# EasyEDA Pro project cubicat_pcb.eprj, schematic Schematic_audio_sdcard_lcd
Create Date: 2024-12-24; Page Name: P1; Project Name: cubicat_CS3; Schematic Name: Schematic_audio_sdcard_lcd; Update Date: 2024-12-24; Company: 嘉立创EDA; Page Size: A4; Version: V1.0
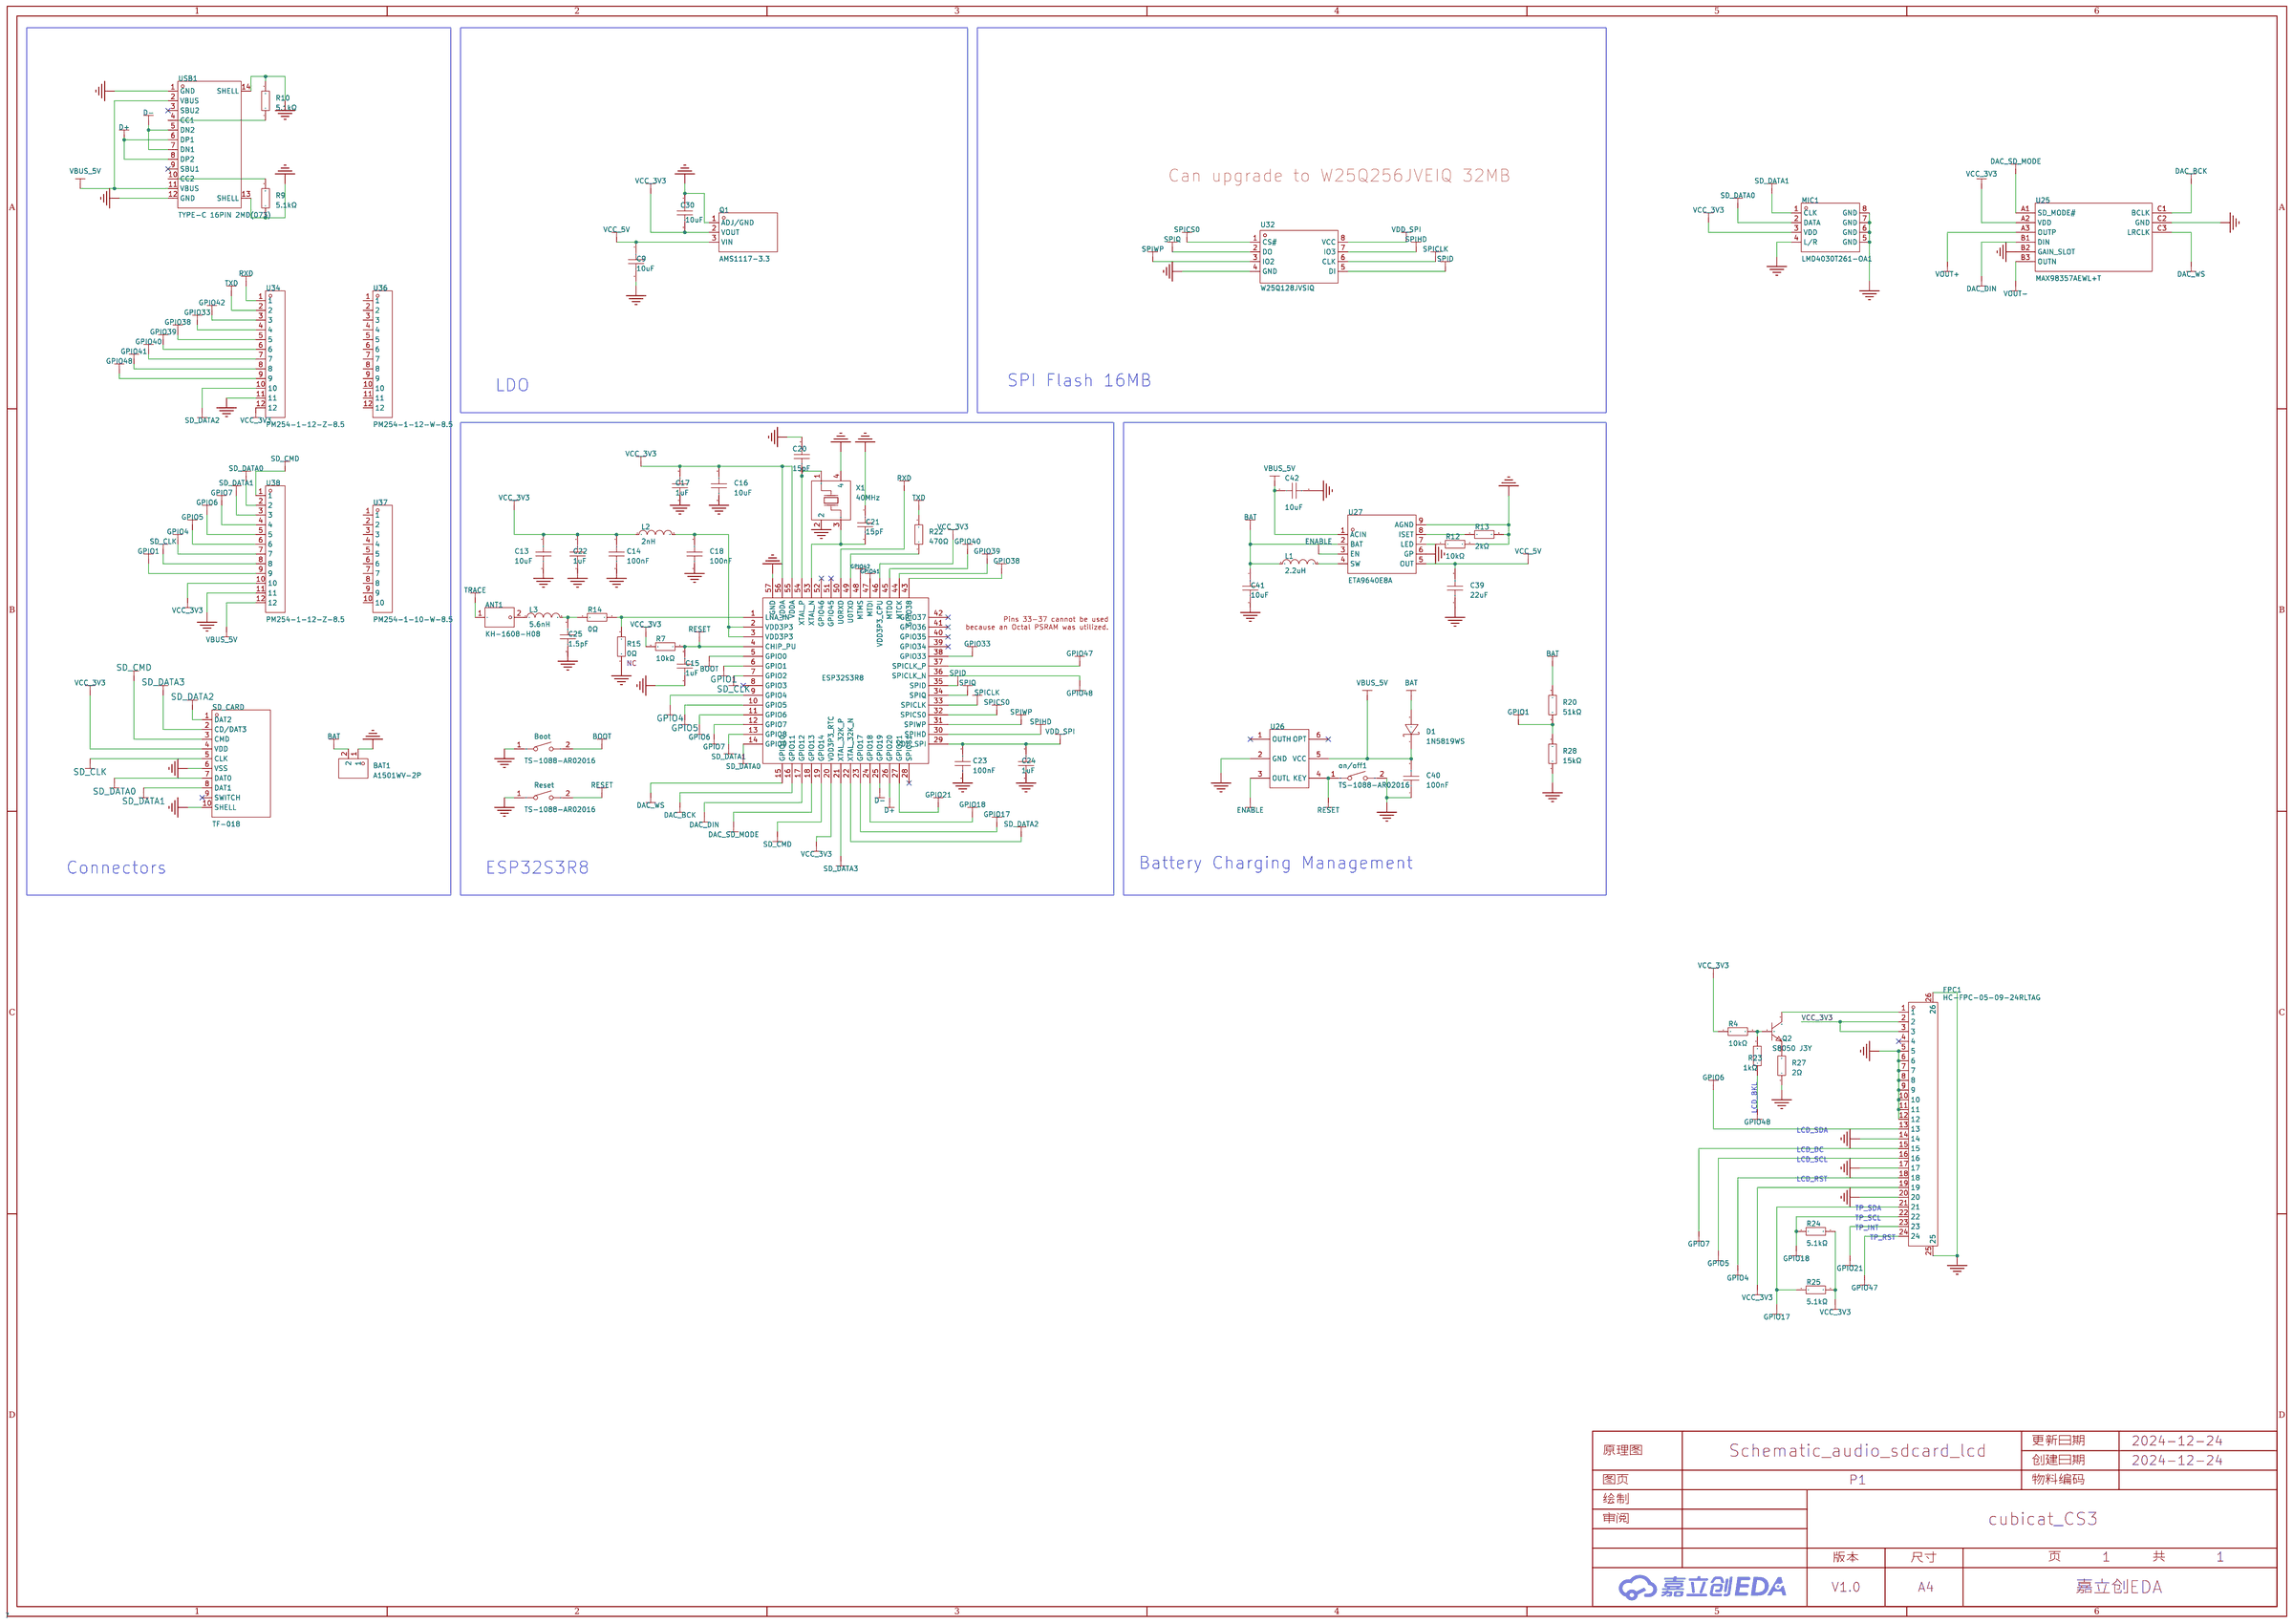
[diagram p3: schematic sheet]

## Parts
ANT1  KH-1608-H08  [ANT-SMD_L1.7-W0.9]
BAT1  A1501WV-2P  [CONN-TH_A1501WV-2P]  (no BOM)
Boot  TS-1088-AR02016  [SW-SMD_L3.9-W3.0-P4.45]
C9  10uF  [C0402]
C13  10uF  [C0402]
C14  100nF  [C0402]
C15  1uF  [C0402]
C16  10uF  [C0402]
C17  1uF  [C0402]
C18  100nF  [C0402]
C20  15pF  [C0402]
C21  15pF  [C0402]
C22  1uF  [C0402]
C23  100nF  [C0402]
C24  1uF  [C0402]
C25  1.5pF  [C0402]
C30  10uF  [C0402]
C39  22uF  [C0603]
C40  100nF  [C0402]
C41  10uF  [C0402]
C42  10uF  [C0402]
D1  1N5819WS  [SOD-323_L1.8-W1.3-LS2.5-RD]
ESP32S3R8  -  [esp32s3R8]
FPC1  HC-FPC-05-09-24RLTAG  [FPC-SMD_24P-P0.50_HC-FPC-05-09-24RLTAG]
L1  2.2uH  [IND-SMD_L2.5-W2.0_MHCHL2520]
L2  2nH  [L0402]
L3  5.6nH  [L0402]
MIC1  LMD4030T261-OA1  [MIC-SMD_8P-L4.0-W3.0]
on/off1  TS-1088-AR02016  [SW-SMD_L3.9-W3.0-P4.45]
Q1  AMS1117-3.3  [SOT-89_L4.5-W2.5-P1.50-LS4.2-BR]
Q2  S8050 J3Y  [SOT-23-3_L3.0-W1.7-P0.95-LS2.9-BR]
R4  10kΩ  [R0402]
R7  10kΩ  [R0402]
R9  5.1kΩ  [R0402]
R10  5.1kΩ  [R0402]
R12  10kΩ  [R0402]
R13  2kΩ  [R0402]
R14  0Ω  [R0402]
R15  0Ω  [R0402]  (no BOM)
R20  51kΩ  [R0402]
R22  470Ω  [R0402]
R23  1kΩ  [R0402]
R24  5.1kΩ  [R0402]
R25  5.1kΩ  [R0402]
R27  2Ω  [R0603]
R28  15kΩ  [R0402]
Reset  TS-1088-AR02016  [SW-SMD_L3.9-W3.0-P4.45]
SD_CARD  TF-018  [TF-SMD_TF-018]  (no BOM)
U25  MAX98357AEWL+T  [WLP-9_L1.4-W1.3-P0.40-R3-C3-BR]
U26  -  [HK015T]
U27  ETA9640E8A  [ESOP-8_L4.9-W3.9-P1.27-LS6.0-BL-EP-1]
U32  W25Q128JVSIQ  [SOIC-8_L5.3-W5.3-P1.27-LS8.0-BL]
U34  PM254-1-12-Z-8.5  [HDR-TH_12P-P2.54-V-F]  (no BOM)
U36  PM254-1-12-W-8.5  [HDR-TH_12P-P2.54-H-F-W10.0-N]
U37  PM254-1-10-W-8.5  [HDR-TH_10P-P2.54-H-F-W10.0-N]
U38  PM254-1-12-Z-8.5  [HDR-TH_12P-P2.54-V-F]  (no BOM)
USB1  TYPE-C 16PIN 2MD(073)  [USB-C-SMD_TYPE-C-6PIN-2MD-073]
X1  40MHz  [osc-smd_4p-l3.2-w2.5-bl_sit8008bi]

## Library data of the parts
ANT1 = KH-1608-H08: Supplier Part: C2925416; Manufacturer: kinghelm(金航标); Supplier Footprint: 0603; JLCPCB Part Class: 扩展库; Datasheet: https://atta.szlcsc.com/upload/public/pdf/source/20211126/3EE7BF0E326A51E5D543950E9041E299.pdf; Supplier: LCSC
BAT1 = A1501WV-2P: 插针结构:1x2P;间距:1.5mm;安装方式:-;参考系列:ZH;总PIN数:2P;排数:1;每排PIN数:2;行距:-;触头材质:黄铜;; LCSC Part Name: 系列:ZH 间距:1.5mm 1x2P; Supplier Part: C225132; Manufacturer: CJT(长江连接器); Supplier Footprint: 插件,P=1.5mm; JLCPCB Part Class: 扩展库; Datasheet: https://atta.szlcsc.com/upload/public/pdf/source/20180928/C273012_BDE11A7ED864817C692E5CB548553229.pdf; Supplier: LCSC; Pins Structure: 1x2P; Pitch: 1.5mm; Reference Series: ZH; Number of Pins: 2P; Number of Rows: 1; Number of PINs Per Row: 2; Contact Material: 黄铜
Boot on/off1 Reset = TS-1088-AR02016: 电路结构:单刀单掷;按钮形状:圆形按钮;作用力:160gf;安装方式:立贴;开关长度:4mm;开关宽度:3mm;开关高度:2mm;带支架:不带;触点电流:50mA;额定电压(DC):12V;绝缘电阻:100MΩ;机械寿命:10万次;; LCSC Part Name: 4*3*2mm 立贴 轻触开关; Supplier Part: C720477; Manufacturer: XUNPU(讯普); Supplier Footprint: SMD; JLCPCB Part Class: 扩展库; Datasheet: https://atta.szlcsc.com/upload/public/pdf/source/20200810/C720475_60D09DD6C54279ADDB2DC25100F1CC11.pdf; Supplier: LCSC; Circuit: 单刀单掷; Actuator Style: 圆形按钮; Operating Force: 160gf; Mounting Style: 立贴; Switch Length: 4mm; Switch Width: 3mm; Switch Height: 2mm; Strike Gundam: 不带; Contact Current: 50mA; Voltage Rating (DC): 12V; Insulation Resistance: 100MΩ; Actuator/Cap Color: 黑色; Pin Style: SMD接片; Mechanical Life: 10万次; Operating Temperature: -30℃~+80℃
C9 C13 C16 C30 C41 C42 = CL05A106MQ5NUNC: 容值:10uF;精度:±20%;额定电压:6.3V;材质(温度系数):X5R;; LCSC Part Name: 10uF ±20% 6.3V; Supplier Part: C15525; Manufacturer: SAMSUNG(三星); Supplier Footprint: 0402; JLCPCB Part Class: Basic Part; Datasheet: https://atta.szlcsc.com/upload/public/pdf/source/20220823/2B02EE04F8F211D38A52DCB16EB6BEBA.pdf; Supplier: LCSC; Tolerance: ±20%; Voltage Rated: 6.3V; Temperature Coefficient: X5R
C14 C18 C23 C40 = CL05B104KO5NNNC: 容值:100nF;精度:±10%;额定电压:16V;材质(温度系数):X7R;; LCSC Part Name: 100nF ±10% 16V; Supplier Part: C1525; Manufacturer: SAMSUNG(三星); Supplier Footprint: 0402; JLCPCB Part Class: Basic Part; Datasheet: https://atta.szlcsc.com/upload/public/pdf/source/20160218/1457707763339.pdf; Supplier: LCSC; Tolerance: ±10%; Voltage Rated: 16V; Temperature Coefficient: X7R
C15 C17 C22 C24 = CL05A105KA5NQNC: 容值:1uF;精度:±10%;额定电压:25V;材质(温度系数):X5R;; LCSC Part Name: 1uF ±10% 25V; Supplier Part: C52923; Manufacturer: SAMSUNG(三星); Supplier Footprint: 0402; JLCPCB Part Class: Basic Part; Datasheet: https://atta.szlcsc.com/upload/public/pdf/source/20160218/1457707763339.pdf; Supplier: LCSC; Tolerance: ±10%; Voltage Rated: 25V; Temperature Coefficient: X5R
C20 C21 = 0402CG150J500NT: 容值:15pF;精度:±5%;额定电压:50V;材质(温度系数):C0G;; LCSC Part Name: 15pF ±5% 50V; Supplier Part: C1548; Manufacturer: FH(风华); Supplier Footprint: 0402; JLCPCB Part Class: Basic Part; Datasheet: https://atta.szlcsc.com/upload/public/pdf/source/20200305/C486355_26A10D38EF8C2A5C37091D0039909270.pdf; Supplier: LCSC; Tolerance: ±5%; Voltage Rated: 50V; Temperature Coefficient: C0G
C25 = CC0402BRNPO9BN1R5: 容值:1.5pF;额定电压:50V;材质(温度系数):NP0;; LCSC Part Name: 1.5pF 50V; Supplier Part: C282238; Manufacturer: YAGEO(国巨); Supplier Footprint: 0402; JLCPCB Part Class: Extended Part; Datasheet: https://atta.szlcsc.com/upload/public/pdf/source/20181008/C309499_21CC21451B82C39E3D92150FD6B30293.pdf; Supplier: LCSC; Voltage Rated: 50V; Temperature Coefficient: NP0
C39 = CL10A226MQ8NRNC: 容值:22uF;精度:±20%;额定电压:6.3V;材质(温度系数):X5R;; LCSC Part Name: 22uF ±20% 6.3V; Supplier Part: C59461; Manufacturer: SAMSUNG(三星); Supplier Footprint: 0603; JLCPCB Part Class: 基础库; Datasheet: https://atta.szlcsc.com/upload/public/pdf/source/20160218/1457707763339.pdf; Supplier: LCSC; Tolerance: ±20%; Voltage Rated: 6.3V; Temperature Coefficient: X5R
D1 = 1N5819WS_C191023: 正向压降(Vf):600mV@1A;直流反向耐压(Vr):40V;平均整流电流(Io):1A;; LCSC Part Name: 电压:40V 电流:1A; Supplier Part: C191023; Manufacturer: Hottech(合科泰); Supplier Footprint: SOD-323; JLCPCB Part Class: 基础库; Datasheet: https://atta.szlcsc.com/upload/public/pdf/source/20220428/3CB86FD8D28D653594B4E35F9D5AEFD9.pdf; Supplier: LCSC; Forward Voltage (Vf@If): 600mV@1A; Reverse Voltage (Vr): 40V; Average Rectified Current (Io): 1A
ESP32S3R8 = esp32s3R8
FPC1 = HC-FPC-05-09-24RLTAG: 锁定特性:翻盖式;触点类型:双侧触点/上下接;触点数量:24P;间距:0.5mm;安装类型:卧贴;工作温度范围:-55℃~+85℃;; LCSC Part Name: 翻盖式 双侧触点/上下接 P数:24P 间距:0.5mm; Supplier Part: C5213757; Manufacturer: HCTL(华灿天禄); Supplier Footprint: SMD,P=0.5mm,卧贴; JLCPCB Part Class: 扩展库; Datasheet: https://atta.szlcsc.com/upload/public/pdf/source/20221026/52A26161A88FCE07A06989F8D4399614.pdf; Supplier: LCSC; Locking Feature: 翻盖式; Contact Type: 双侧触点/上下接; Number of Contacts: 24P; Pitch: 0.5mm; Mounting Type: 卧贴; FFC, FCB Thickness: 0.3mm; Height Above Board: 1mm; Contact Material: 铜合金; Operating Temperature Range: -55℃~+85℃
L1 = FTC252012S2R2MBCA: 电感值:2.2uH;精度:±20%;额定电流:3A;饱和电流(Isat):3.8A;类型:一体成型电感;; LCSC Part Name: 2.2uH ±20% 3.8A; Supplier Part: C5832372; Manufacturer: cjiang(长江微电); Supplier Footprint: 1008; JLCPCB Part Class: Extended Part; Datasheet: https://atta.szlcsc.com/upload/public/pdf/source/20230602/8FFEDA9C0247A92A0D4B67554BFE4091.pdf; Supplier: LCSC; Tolerance: ±20%; Rated Current: 3A; Saturation Current (Isat): 3.8A; DC Resistance (DCR): 55mΩ; Type: 一体成型电感
L2 = MLG1005S2N0BT000: 电感值:2nH;精度:-;额定电流:900mA;饱和电流(Isat):-;直流电阻(DCR):70mΩ;; Supplier Part: C76769; Manufacturer: TDK; Supplier Footprint: 0402; JLCPCB Part Class: 扩展库; Datasheet: https://atta.szlcsc.com/upload/public/pdf/source/20190403/C275259_14D38AC9DF218780897673DFAA345BA3.pdf; Supplier: LCSC; Rated Current: 900mA; DC Resistance (DCR): 70mΩ; Q @ Freq: 7@100MHz; Frequency - Self Resonant: 7.5GHz
L3 = LQG15HS5N6S02D: 电感值:5.6nH;精度:-;额定电流:650mA;饱和电流(Isat):-;直流电阻(DCR):180mΩ;; Supplier Part: C85670; Manufacturer: muRata(村田); Supplier Footprint: 0402; JLCPCB Part Class: Extended Part; Datasheet: https://atta.szlcsc.com/upload/public/pdf/source/20180612/C185484_14F678484DDF036353DC67B6265A9221.pdf; Supplier: LCSC; Rated Current: 650mA; DC Resistance (DCR): 180mΩ; Q @ Freq: 8@100MHz; Frequency - Self Resonant: 4.5GHz; Type: 厚膜电感
MIC1 = LMD4030T261-OA1: 方向:全指向;信噪比:58dB;灵敏度:-26dB;; LCSC Part Name: MEMSmic数字硅麦4030 上进音 s-26db±1 LMD:聆麦数字麦克风/4030:尺寸/T:上进音/261:-26±1dB; Supplier Part: C7587900; Manufacturer: LinkMems(聆麦声学); Supplier Footprint: SMD-8P,4x3mm; JLCPCB Part Class: 扩展库; Datasheet: https://atta.szlcsc.com/upload/public/pdf/source/20240604/6AD6E72D027EE067978D4D8B0B115A58.pdf; Supplier: LCSC; Direction: 全指向; Supply Voltage: 1.62V~3.6V; Current Consumption: 750uA; SNR(Signal to Noise Ratio): 58dB; Sensitivity: -26dB
Q1 = AMS1117-3.3_C347256: 输出类型:固定;最大输入电压:12V;输出电压:3.3V;最大输出电流:1A;电源纹波抑制比(PSRR):60dB@(120Hz);输出极性:正极;; LCSC Part Name: 输出:3.3V 电流:1A 耐压:12V; Supplier Part: C347256; Manufacturer: UMW(友台半导体); Supplier Footprint: SOT-89; JLCPCB Part Class: Extended Part; Datasheet: https://atta.szlcsc.com/upload/public/pdf/source/20231109/155D79A26D9DB04352555A58D5969DC8.pdf; Supplier: LCSC; Output Type: 固定; Maximum Input Voltage: 12V; Output Voltage: 3.3V; MAX Output Current: 1A; Power Supply Rejection Ratio (PSRR): 60dB@(120Hz); Dropout Voltage: 1.3V@(1A); Output Polarity: 正极; Number of Outputs: 1
Q2 = S8050 J3Y_C2146: 晶体管类型:NPN;集电极电流(Ic):500mA;集射极击穿电压(Vceo):25V;功率(Pd):300mW;直流电流增益(hFE@Ic,Vce):200@50mA,1V;; LCSC Part Name: S8050 J3Y(RANGE:200-350) H档(200-350); Supplier Part: C2146; Manufacturer: CJ(江苏长电/长晶); Supplier Footprint: SOT-23; JLCPCB Part Class: 基础库; Datasheet: https://atta.szlcsc.com/upload/public/pdf/source/20140809/1457707209234.pdf; Supplier: LCSC; Transistor Type: NPN; Collector Current (Ic): 500mA; Collector-Emitter Breakdown Voltage (Vceo): 25V; Power Dissipation (Pd): 300mW; DC Current Gain (hFE@Ic,Vce): 200@50mA,1V; Transition Frequency (fT): 150MHz; Collector Cut-Off Current (Icbo): 100nA; Collector-Emitter Saturation Voltage (VCE(sat)@Ic,Ib): 600mV@500mA,50mA
R4 R7 R12 = 0402WGF1002TCE: 电阻类型:厚膜电阻;阻值:10kΩ;精度:±1%;功率:62.5mW;最大工作电压:50V;温度系数:±100ppm/℃;; LCSC Part Name: 10kΩ ±1% 62.5mW 厚膜电阻; Supplier Part: C25744; Manufacturer: UNI-ROYAL(厚声); Supplier Footprint: 0402; JLCPCB Part Class: Basic Part; Datasheet: https://atta.szlcsc.com/upload/public/pdf/source/20200306/C422600_1E6D84923E4A46A82E41ADD87F860B5C.pdf; Supplier: LCSC; Type: 厚膜电阻; Tolerance: ±1%; Power(Watts): 62.5mW; Overload Voltage (Max): 50V; Temperature Coefficient: ±100ppm/℃; Operating Temperature Range: -55℃~+155℃
R9 R10 R24 R25 = 0402WGF5101TCE: 电阻类型:厚膜电阻;阻值:5.1kΩ;精度:±1%;功率:62.5mW;最大工作电压:50V;温度系数:±100ppm/℃;; LCSC Part Name: 5.1kΩ ±1% 62.5mW 厚膜电阻; Supplier Part: C25905; Manufacturer: UNI-ROYAL(厚声); Supplier Footprint: 0402; JLCPCB Part Class: Basic Part; Datasheet: https://atta.szlcsc.com/upload/public/pdf/source/20200306/C422600_1E6D84923E4A46A82E41ADD87F860B5C.pdf; Supplier: LCSC; Type: 厚膜电阻; Tolerance: ±1%; Power(Watts): 62.5mW; Overload Voltage (Max): 50V; Temperature Coefficient: ±100ppm/℃; Operating Temperature Range: -55℃~+155℃
R13 = 0402WGF2001TCE: 电阻类型:厚膜电阻;阻值:2kΩ;精度:±1%;功率:62.5mW;最大工作电压:50V;温度系数:±100ppm/℃;; LCSC Part Name: 2kΩ ±1% 62.5mW 厚膜电阻; Supplier Part: C4109; Manufacturer: UNI-ROYAL(厚声); Supplier Footprint: 0402; JLCPCB Part Class: Basic Part; Datasheet: https://atta.szlcsc.com/upload/public/pdf/source/20200306/C422600_1E6D84923E4A46A82E41ADD87F860B5C.pdf; Supplier: LCSC; Type: 厚膜电阻; Tolerance: ±1%; Power(Watts): 62.5mW; Overload Voltage (Max): 50V; Temperature Coefficient: ±100ppm/℃; Operating Temperature Range: -55℃~+155℃
R14 = 0402WGF0000TCE: 电阻类型:厚膜电阻;阻值:0Ω;精度:±1%;功率:62.5mW;最大工作电压:50V;温度系数:±800ppm/℃;; LCSC Part Name: 0Ω ±1% 62.5mW 厚膜电阻; Supplier Part: C17168; Manufacturer: UNI-ROYAL(厚声); Supplier Footprint: 0402; JLCPCB Part Class: Basic Part; Datasheet: https://atta.szlcsc.com/upload/public/pdf/source/20200306/C422600_1E6D84923E4A46A82E41ADD87F860B5C.pdf; Supplier: LCSC; Type: 厚膜电阻; Tolerance: ±1%; Power(Watts): 62.5mW; Overload Voltage (Max): 50V; Temperature Coefficient: ±800ppm/℃; Operating Temperature Range: -55℃~+155℃
R15 = 0402WGF0000TCE: 电阻类型:厚膜电阻;阻值:0Ω;精度:±1%;功率:62.5mW;最大工作电压:50V;温度系数:±800ppm/℃;; LCSC Part Name: 0Ω ±1% 62.5mW 厚膜电阻; Supplier Part: C25087; Manufacturer: UNI-ROYAL(厚声); Supplier Footprint: 0402; JLCPCB Part Class: 基础库; Datasheet: https://atta.szlcsc.com/upload/public/pdf/source/20200306/C422600_1E6D84923E4A46A82E41ADD87F860B5C.pdf; Supplier: LCSC; Type: 厚膜电阻; Tolerance: ±1%; Power(Watts): 62.5mW; Overload Voltage (Max): 50V; Temperature Coefficient: ±800ppm/℃; Operating Temperature Range: -55℃~+155℃; Comment: NC
R20 = 0402WGF5102TCE: 电阻类型:厚膜电阻;阻值:51kΩ;精度:±1%;功率:62.5mW;最大工作电压:50V;温度系数:±100ppm/℃;; LCSC Part Name: 51kΩ ±1% 62.5mW 厚膜电阻; Supplier Part: C25794; Manufacturer: UNI-ROYAL(厚声); Supplier Footprint: 0402; JLCPCB Part Class: 基础库; Datasheet: https://atta.szlcsc.com/upload/public/pdf/source/20200306/C422600_1E6D84923E4A46A82E41ADD87F860B5C.pdf; Supplier: LCSC; Type: 厚膜电阻; Tolerance: ±1%; Power(Watts): 62.5mW; Overload Voltage (Max): 50V; Temperature Coefficient: ±100ppm/℃; Operating Temperature Range: -55℃~+155℃
R22 = 0402WGF4700TCE: 电阻类型:厚膜电阻;阻值:470Ω;精度:±1%;功率:62.5mW;最大工作电压:50V;温度系数:±100ppm/℃;; LCSC Part Name: 470Ω ±1% 62.5mW 厚膜电阻; Supplier Part: C25117; Manufacturer: UNI-ROYAL(厚声); Supplier Footprint: 0402; JLCPCB Part Class: 基础库; Datasheet: https://atta.szlcsc.com/upload/public/pdf/source/20200306/C422600_1E6D84923E4A46A82E41ADD87F860B5C.pdf; Supplier: LCSC; Type: 厚膜电阻; Tolerance: ±1%; Power(Watts): 62.5mW; Overload Voltage (Max): 50V; Temperature Coefficient: ±100ppm/℃; Operating Temperature Range: -55℃~+155℃
R23 = 0402WGF1001TCE: 电阻类型:厚膜电阻;阻值:1kΩ;精度:±1%;功率:62.5mW;最大工作电压:50V;温度系数:±100ppm/℃;; LCSC Part Name: 1kΩ ±1% 62.5mW 厚膜电阻; Supplier Part: C11702; Manufacturer: UNI-ROYAL(厚声); Supplier Footprint: 0402; JLCPCB Part Class: 基础库; Datasheet: https://atta.szlcsc.com/upload/public/pdf/source/20200306/C422600_1E6D84923E4A46A82E41ADD87F860B5C.pdf; Supplier: LCSC; Type: 厚膜电阻; Tolerance: ±1%; Power(Watts): 62.5mW; Overload Voltage (Max): 50V; Temperature Coefficient: ±100ppm/℃; Operating Temperature Range: -55℃~+155℃
R27 = 0603WAF200KT5E: 电阻类型:厚膜电阻;阻值:2Ω;精度:±1%;功率:100mW;最大工作电压:75V;温度系数:±200ppm/℃;; LCSC Part Name: 2Ω ±1% 100mW 厚膜电阻; Supplier Part: C22977; Manufacturer: UNI-ROYAL(厚声); Supplier Footprint: 0603; JLCPCB Part Class: Basic Part; Datasheet: https://atta.szlcsc.com/upload/public/pdf/source/20200306/C422600_1E6D84923E4A46A82E41ADD87F860B5C.pdf; Supplier: LCSC; Type: 厚膜电阻; Tolerance: ±1%; Power(Watts): 100mW; Overload Voltage (Max): 75V; Temperature Coefficient: ±200ppm/℃; Operating Temperature Range: -55℃~+155℃
R28 = 0402WGF1502TCE: 电阻类型:厚膜电阻;阻值:15kΩ;精度:±1%;功率:62.5mW;最大工作电压:50V;温度系数:±100ppm/℃;; LCSC Part Name: 15kΩ ±1% 62.5mW 厚膜电阻; Supplier Part: C25756; Manufacturer: UNI-ROYAL(厚声); Supplier Footprint: 0402; JLCPCB Part Class: 基础库; Datasheet: https://atta.szlcsc.com/upload/public/pdf/source/20200306/C422600_1E6D84923E4A46A82E41ADD87F860B5C.pdf; Supplier: LCSC; Type: 厚膜电阻; Tolerance: ±1%; Power(Watts): 62.5mW; Overload Voltage (Max): 50V; Temperature Coefficient: ±100ppm/℃; Operating Temperature Range: -55℃~+155℃
SD_CARD = TF-018: 卡连接方式:拔插式;卡类型:MicroSD卡(TF卡);连接器类型:卡座;本体最大高度:1.5mm;触头镀层:金;工作温度范围:-25℃~+85℃;; LCSC Part Name: 拔插式 MicroSD卡(TF卡) 卡座; Supplier Part: C961679; Manufacturer: HANBO(汉博); Supplier Footprint: SMD; JLCPCB Part Class: 扩展库; Datasheet: https://atta.szlcsc.com/upload/public/pdf/source/20221111/2928BC23ED293CD708B2624B434E0C57.pdf; Supplier: LCSC; Card Connection Mode: 拔插式; Card Type: MicroSD卡(TF卡); Connector Type: 卡座; Maximum Body Height: 1.5mm; Contact Plating: 金; Operating Temperature Range: -25℃~+85℃
U25 = MAX98357AEWL+T: 功放类型:-;扬声器通道数:单声道;输出功率:3.2Wx2@4Ω;; Supplier Part: C2682619; Manufacturer: ADI(亚德诺)/MAXIM(美信); Supplier Footprint: BGA-9(1.3x1.3); JLCPCB Part Class: 扩展库; Datasheet: https://atta.szlcsc.com/upload/public/pdf/source/20210106/C2682619_15CCD654F2C559A2FC5FDCA8EA0D4E6D.pdf; Supplier: LCSC; Speaker Channels: 单声道; Output Power: 3.2Wx2@4Ω; Supply Voltage: 2.5V~5.5V; Operating Temperature: -40℃~+85℃
U26 = HK015T
U27 = ETA9640E8A_C7465502: Supplier Part: C7465502; Manufacturer: ETA(钰泰); Supplier Footprint: ESOP8; JLCPCB Part Class: 扩展库; Datasheet: https://atta.szlcsc.com/upload/public/pdf/source/20230717/83E2131BCBB0096DE2AAA145D2B6BC4E.pdf; Supplier: LCSC
U32 = W25Q128JVSIQ: 接口类型:-;存储容量:128Mbit;时钟频率(fc):-;; LCSC Part Name: W25Q128JVSIQ 编带; Supplier Part: C97521; Manufacturer: WINBOND(华邦); Supplier Footprint: SOIC-8-208mil; JLCPCB Part Class: 基础库; Datasheet: https://atta.szlcsc.com/upload/public/pdf/source/20170316/1489627409956.pdf; Supplier: LCSC; Memory Size: 128Mbit
U34 U38 = PM254-1-12-Z-8.5: 插孔结构:1x12P;间距:2.54mm;行距:-;圆孔/方孔:方孔;安装类型:直插;排数:单排;总孔位数:12P;额定电流:3A;额定电压:-;插孔方向:顶部;塑高:8.5mm;触头材质:铜合金;工作温度范围:-40℃~+105℃;焊接温度(最大值):260℃@5S;; LCSC Part Name: 1x12P 间距:2.54mm 直插; Supplier Part: C2897375; Manufacturer: HCTL(华灿天禄); Supplier Footprint: 插件,P=2.54mm; JLCPCB Part Class: 扩展库; Datasheet: https://atta.szlcsc.com/upload/public/pdf/source/20230609/534BE42964C679BDE98E061007C4ABD6.pdf; Supplier: LCSC; Holes Structure: 1x12P; Pitch: 2.54mm; Circular Hole / Square Hole: 方孔; Mounting Type: 直插; Number of Rows: 单排; Number of Holes: 12P; Current Rating (Max): 3A; Holes Direction: 顶部; Insulation Height: 8.5mm; Contact Material: 铜合金; Operating Temperature Range: -40℃~+105℃; Soldering Temperature(Max): 260℃@5S
U36 = PM254-1-12-W-8.5: 插孔结构:1x12P;间距:2.54mm;行距:-;圆孔/方孔:方孔;安装类型:弯插;排数:单排;总孔位数:12P;额定电流:3A;额定电压:-;插孔方向:侧面;塑高:8.5mm;触头材质:铜合金;工作温度范围:-40℃~+105℃;焊接温度(最大值):260℃@5S;; LCSC Part Name: 1x12P 间距:2.54mm 弯插; Supplier Part: C2897394; Manufacturer: HCTL(华灿天禄); Supplier Footprint: 弯插,P=2.54mm; JLCPCB Part Class: 扩展库; Datasheet: https://atta.szlcsc.com/upload/public/pdf/source/20230609/7BA40A3D721268A082DCDEAD4C99131B.pdf; Supplier: LCSC; Holes Structure: 1x12P; Pitch: 2.54mm; Circular Hole / Square Hole: 方孔; Mounting Type: 弯插; Number of Rows: 单排; Number of Holes: 12P; Current Rating (Max): 3A; Holes Direction: 侧面; Insulation Height: 8.5mm; Contact Material: 铜合金; Operating Temperature Range: -40℃~+105℃; Soldering Temperature(Max): 260℃@5S
U37 = PM254-1-10-W-8.5: 插孔结构:1x10P;间距:2.54mm;行距:-;圆孔/方孔:方孔;安装类型:弯插;排数:单排;总孔位数:10P;额定电流:3A;额定电压:-;插孔方向:侧面;塑高:8.5mm;触头材质:铜合金;工作温度范围:-40℃~+105℃;焊接温度(最大值):260℃@5S;; LCSC Part Name: 1x10P 间距:2.54mm 弯插; Supplier Part: C2897392; Manufacturer: HCTL(华灿天禄); Supplier Footprint: 弯插,P=2.54mm; JLCPCB Part Class: 扩展库; Datasheet: https://atta.szlcsc.com/upload/public/pdf/source/20230609/7BA40A3D721268A082DCDEAD4C99131B.pdf; Supplier: LCSC; Holes Structure: 1x10P; Pitch: 2.54mm; Circular Hole / Square Hole: 方孔; Mounting Type: 弯插; Number of Rows: 单排; Number of Holes: 10P; Current Rating (Max): 3A; Holes Direction: 侧面; Insulation Height: 8.5mm; Contact Material: 铜合金; Operating Temperature Range: -40℃~+105℃; Soldering Temperature(Max): 260℃@5S
USB1 = TYPE-C 16PIN 2MD(073): 连接器类型:Type-C;标准:-;公母:母;端口数量:1;触点数量:16P;安装方式:卧贴;额定电流 - 电源:5A;工作温度范围:-25℃~+85℃;; LCSC Part Name: Type-C 母 卧贴; Supplier Part: C2765186; Manufacturer: SHOU HAN(首韩); Supplier Footprint: SMD; JLCPCB Part Class: 扩展库; Datasheet: https://atta.szlcsc.com/upload/public/pdf/source/20211123/39B17C16241EAC15C5E277BDA434118E.pdf; Supplier: LCSC; Connector Type: Type-C; Gender: 母; Number of Ports: 1; Number of Contacts: 16P; Mounting Style: 卧贴; Current Rating - Power (Max): 5A; Operating Temperature Range: -25℃~+85℃
X1 = X322540MPB4SI: 晶振类型:贴片晶振;频率:40MHz;常温频差:±10ppm;外接负载电容:15pF;频率稳定度(全温):±20ppm;; LCSC Part Name: 40MHz ±10ppm 15pF; Supplier Part: C9010; Manufacturer: YXC(扬兴晶振); Supplier Footprint: SMD3225-4P; JLCPCB Part Class: Extended Part; Datasheet: https://atta.szlcsc.com/upload/public/pdf/source/20240329/19D5F850207469550BEB00D7DFEDBC7A.pdf; Supplier: LCSC; Crystal Type: 贴片晶振; Normal temperature Frequency Tolerance: ±10ppm; External load capacitor: 15pF; Frequency Stability(Full temperature range): ±20ppm; Operating Temperature: -40℃~+85℃; Equivalent Series Resistance (ESR): 25Ω

## Nets
GND: BAT1.1 Boot.1 C9.2 C13.1 C14.1 C15.1 C16.1 C17.1 C18.1 C20.2 C21.1 C22.1 C23.1 C24.1 C25.1 C30.1 C39.1 C40.1 C41.2 C42.2 ESP32S3R8.57(GND) FPC1.5 FPC1.6 FPC1.7 FPC1.8 FPC1.9 FPC1.10 FPC1.11 FPC1.12 FPC1.14 FPC1.17 FPC1.20 FPC1.25 FPC1.26 MIC1.4(L/R) MIC1.5(GND) MIC1.6(GND) MIC1.7(GND) MIC1.8(GND) on/off1.2 Q1.1(ADJ/GND) R9.1 R10.2 R12.2 R13.2 R15.1 R27.1 R28.1 Reset.1 SD_CARD.6(VSS) SD_CARD.10(SHELL) U25.B2(GAIN_SLOT) U25.C2(GND) U26.2(GND) U27.6(GP) U27.9(AGND) U32.4(GND) U34.11 U38.11 USB1.1(GND) USB1.12(GND) USB1.13(SHELL) USB1.14(SHELL) X1.2 X1.4
VBUS_5V: C40.2 C42.1 D1.1(K) U26.5(VCC) U27.1(ACIN) U38.12 USB1.2(VBUS) USB1.11(VBUS)
VCC_3V3: C13.2 C14.2 C16.2 C17.2 C22.2 C30.2 ESP32S3R8.20(VDD3P3_RTC) ESP32S3R8.46(VDD3P3_CPU) ESP32S3R8.55(VDDA) ESP32S3R8.56(VDDA) FPC1.2 FPC1.3 FPC1.19 L2.1 MIC1.3(VDD) Q1.2(VOUT) R4.1 R7.2 R24.2 R25.2 SD_CARD.4(VDD) U25.A2(VDD) U34.12 U38.10
VCC_5V: C9.1 C39.2 Q1.3(VIN) U27.5(OUT)
VDD_SPI: C23.2 C24.2 ESP32S3R8.29(VDD_SPI) U32.8(VCC)
BAT: BAT1.2 C41.1 D1.2(A) L1.1 R20.2 U27.2(BAT)
BOOT: Boot.2 ESP32S3R8.5(GPIO0)
D+: ESP32S3R8.26(GPIO20) USB1.6(DP1) USB1.8(DP2)
D-: ESP32S3R8.25(GPIO19) USB1.5(DN2) USB1.7(DN1)
DAC_BCK: ESP32S3R8.16(GPIO11) U25.C1(BCLK)
DAC_DIN: ESP32S3R8.17(GPIO12) U25.B1(DIN)
DAC_SD_MODE: ESP32S3R8.18(GPIO13) U25.A1(SD_MODE#)
DAC_WS: ESP32S3R8.15(GPIO10) U25.C3(LRCLK)
ENABLE: U26.3(OUTL) U27.3(EN)
GPIO1: ESP32S3R8.6(GPIO1) R20.1 R28.2 U38.9
GPIO4: ESP32S3R8.9(GPIO4) FPC1.18 U38.7
GPIO5: ESP32S3R8.10(GPIO5) FPC1.16 U38.6
GPIO6: ESP32S3R8.11(GPIO6) FPC1.13 U38.5
GPIO7: ESP32S3R8.12(GPIO7) FPC1.15 U38.4
GPIO17: ESP32S3R8.23(GPIO17) FPC1.21 R25.1
GPIO18: ESP32S3R8.24(GPIO18) FPC1.22 R24.1
GPIO21: ESP32S3R8.27(GPIO21) FPC1.23
GPIO33: ESP32S3R8.38(GPIO33) U34.4
GPIO38: ESP32S3R8.43(GPIO38) U34.5
GPIO39: ESP32S3R8.44(MTCK) U34.6
GPIO40: ESP32S3R8.45(MTDO) U34.7
GPIO41: ESP32S3R8.47(MTDI) U34.8
GPIO42: ESP32S3R8.48(MTMS) U34.3
GPIO47: ESP32S3R8.37(SPICLK_P) FPC1.24
GPIO48: ESP32S3R8.36(SPICLK_N) R23.1 U34.9
RESET: C15.2 ESP32S3R8.4(CHIP_PU) on/off1.1 R7.1 Reset.2 U26.4(KEY)
RXD: ESP32S3R8.50(U0RXD) U34.1
SD_CLK: ESP32S3R8.7(GPIO2) SD_CARD.5(CLK) U38.8
SD_CMD: ESP32S3R8.19(GPIO14) SD_CARD.3(CMD) U38.1
SD_DATA0: ESP32S3R8.14(GPIO9) MIC1.2(DATA) SD_CARD.7(DAT0) U38.2
SD_DATA1: ESP32S3R8.13(GPIO8) MIC1.1(CLK) SD_CARD.8(DAT1) U38.3
SD_DATA2: ESP32S3R8.22(XTAL_32K_N) SD_CARD.1(DAT2) U34.10
SD_DATA3: ESP32S3R8.21(XTAL_32K_P) SD_CARD.2(CD/DAT3)
SPICLK: ESP32S3R8.33(SPICLK) U32.6(CLK)
SPICS0: ESP32S3R8.32(SPICS0) U32.1(CS#)
SPID: ESP32S3R8.35(SPID) U32.5(DI)
SPIHD: ESP32S3R8.30(SPIHD) U32.7(IO3)
SPIQ: ESP32S3R8.34(SPIQ) U32.2(DO)
SPIWP: ESP32S3R8.31(SPIWP) U32.3(IO2)
TRACE: ANT1.1
TXD: R22.2 U34.2
VOUT+: U25.A3(OUTP)
VOUT-: U25.B3(OUTN)
$1N4090: R10.1 USB1.4(CC1)
$1N4091: R9.2 USB1.10(CC2)
$1N4114: C21.2 ESP32S3R8.53(XTAL_N) X1.3(OSC2)
$1N4115: C20.1 ESP32S3R8.54(XTAL_P) X1.1(OSC1)
$1N4126: C18.2 ESP32S3R8.2(VDD3P3) ESP32S3R8.3(VDD3P3) L2.2
$1N4130: ANT1.2 L3.1
$1N4132: C25.2 L3.2 R14.1
$1N4134: ESP32S3R8.1(LNA_IN) R14.2 R15.2
$1N4203: ESP32S3R8.49(U0TXD) R22.1
$1N60344: FPC1.1 Q2.3(C)
$1N60345: Q2.1(B) R4.2 R23.2
$1N71273: Q2.2(E) R27.2
$1N78702: R13.1 U27.8(ISET)
$1N78703: R12.1 U27.7(LED)
$1N78706: L1.2 U27.4(SW)

Not connected (* = marked no-connect by the designer): ESP32S3R8 8(GPIO3)* 28(SPICS1)* 39(GPIO34)* 40(GPIO35)* 41(GPIO36)* 42(GPIO37)* 51(GPIO45)* 52(GPIO46)*; FPC1 4*; SD_CARD 9(SWITCH)*; U26 1(OUTH)* 6(OPT)*; U36 1 2 3 4 5 6 7 8 9 10 11 12; U37 1 2 3 4 5 6 7 8 9 10; USB1 3(SBU2)* 9(SBU1)*

## Notes on the sheet
- Can upgrade to W25Q256JVEIQ 32MB
- SPI Flash 16MB
- LDO
- Pins 33-37 cannot be used
  because an Octal PSRAM was utilized.
- Battery Charging Management
- Connectors
- ESP32S3R8
- LCD_BKL
- LCD_SDA
- LCD_DC
- LCD_SCL
- LCD_RST
- TP_SDA
- TP_SCL
- TP_INT
- TP_RST
